# EasyEDA Pro project BlueberryPi.eprj, board PCB1 (continued)
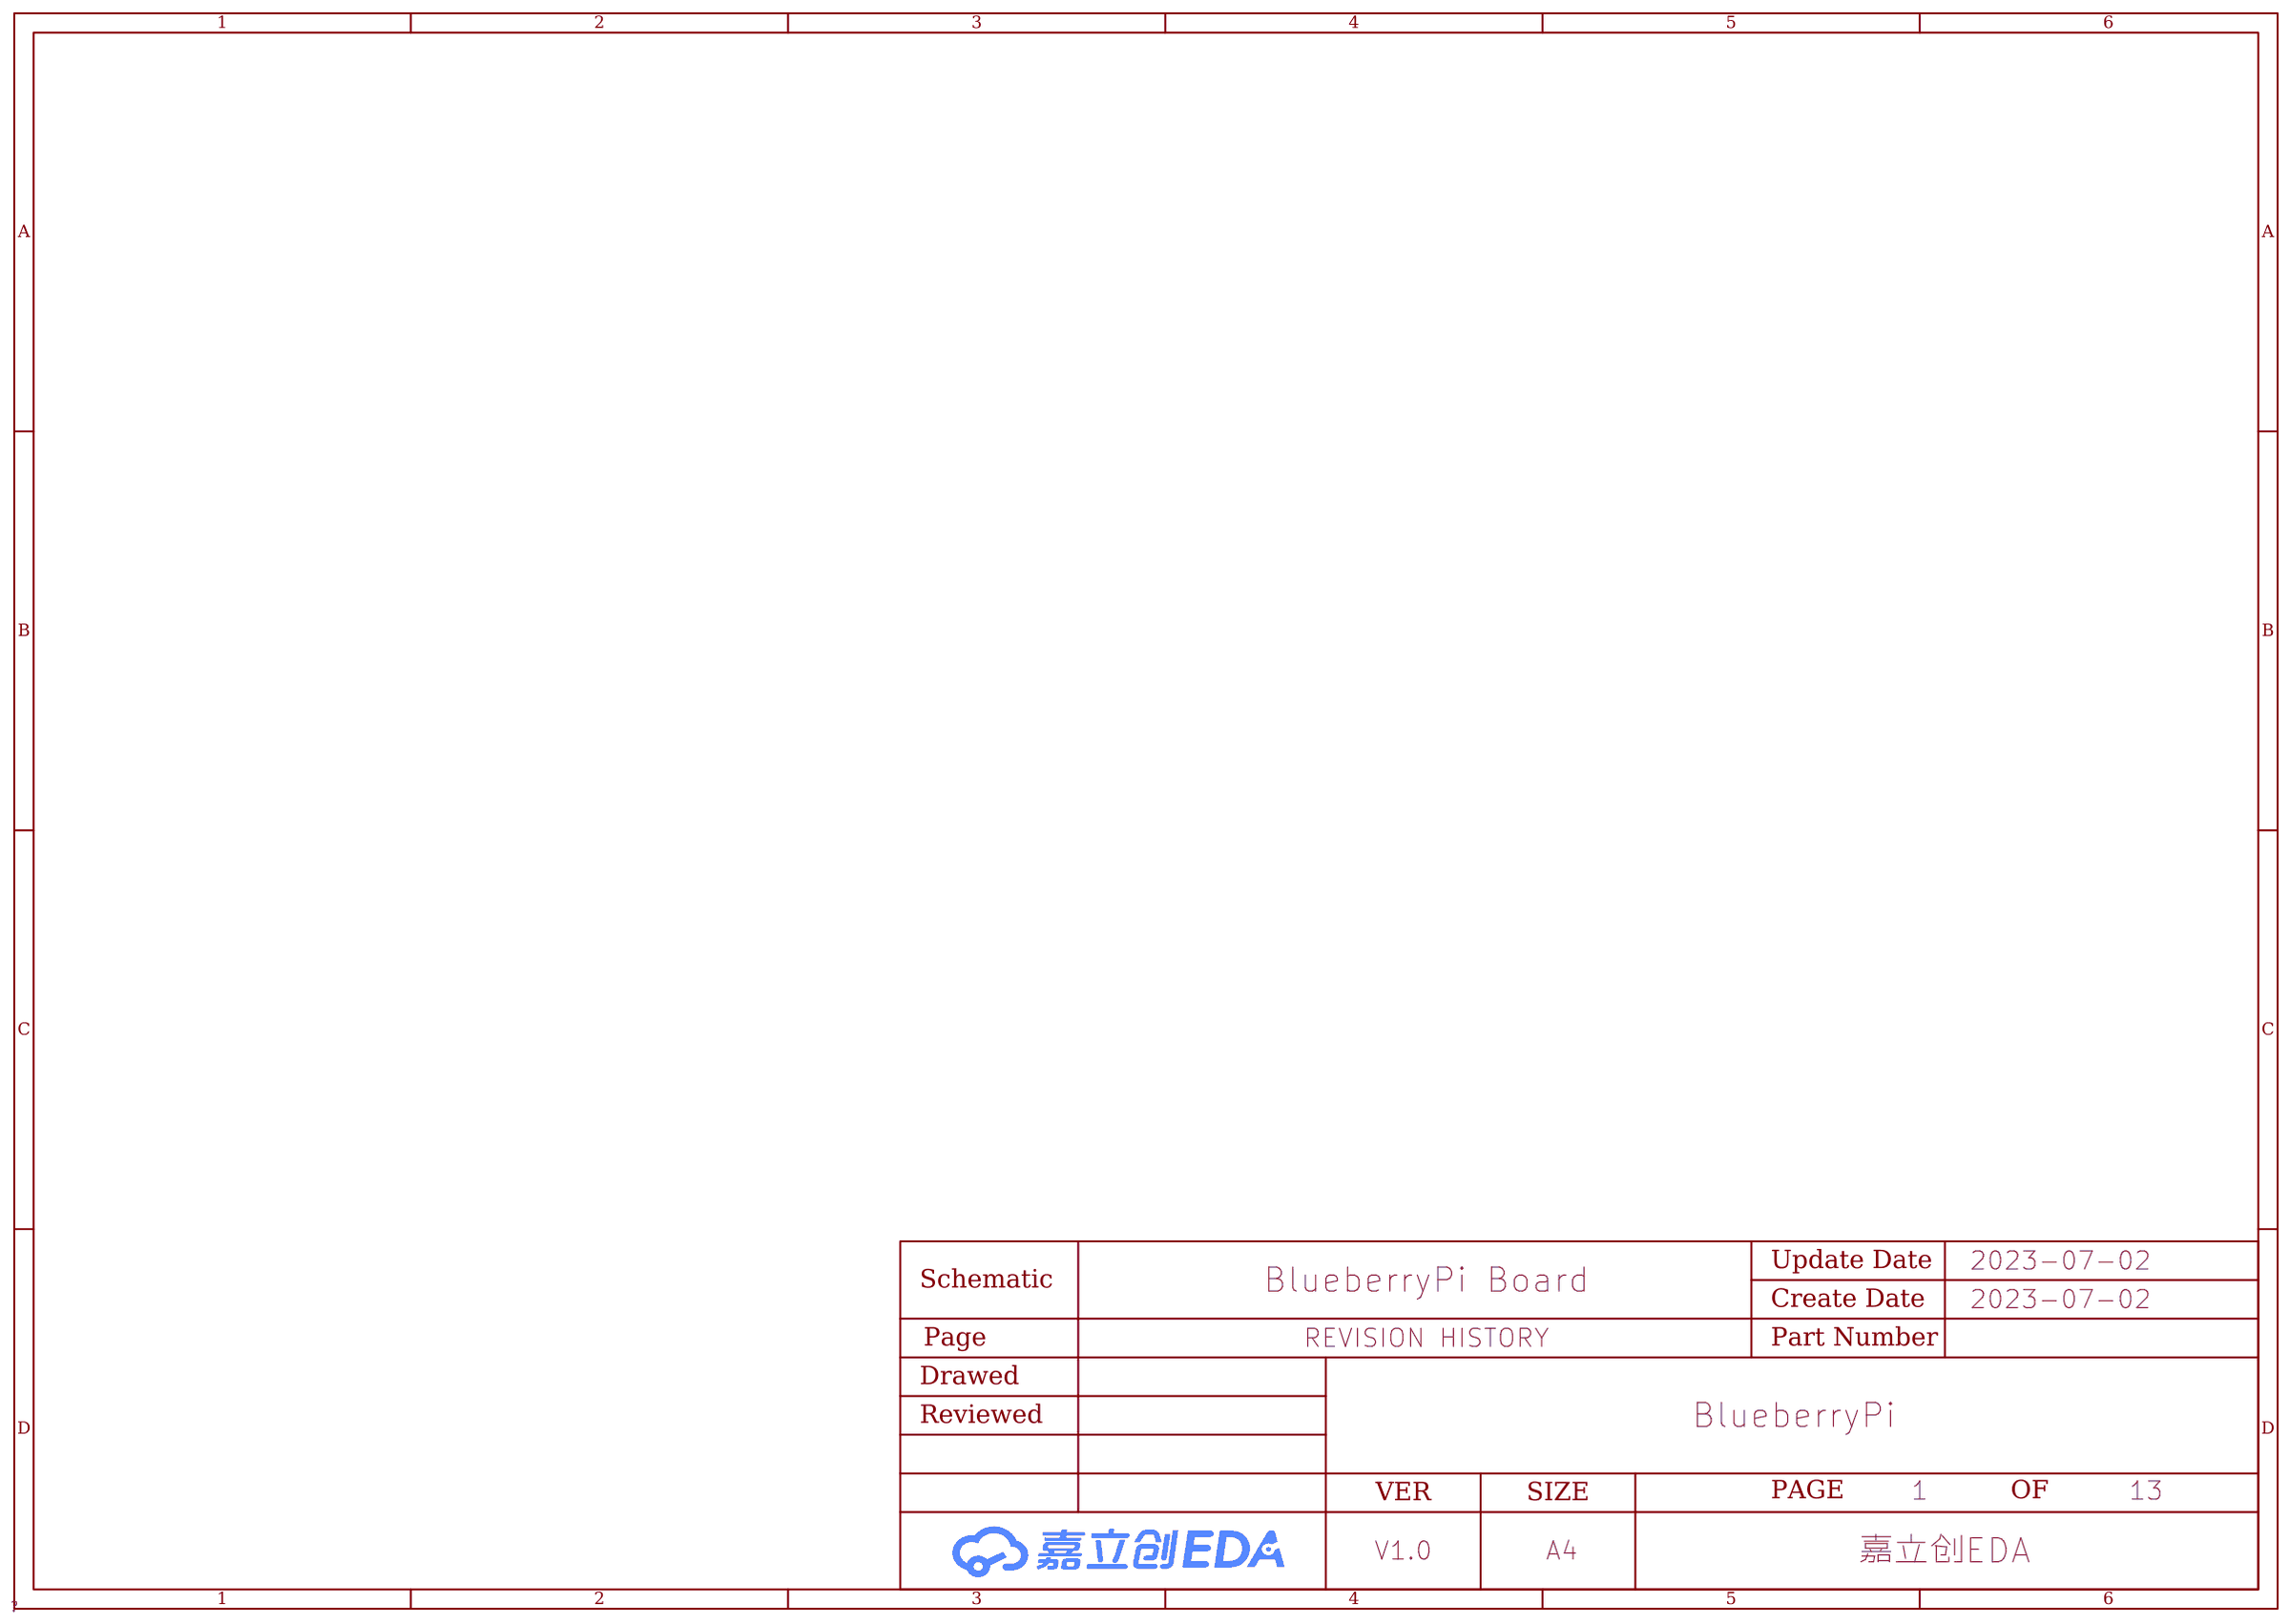
[diagram p0: REVISION HISTORY]
## Routing (per net, layer and track width the routed paths; a pad name or vN(x,y) marks a point on that pad's centre or on a via; arc(x,y) is an arc through that point) (continued)
HTX0P: length 40.8
  Top Layer w0.102: U1.A19 54.19,56.79 54.19,56.92 54.06,57.05 54.06,57.23 54.19,57.35 54.19,57.53 54.06,57.66 54.06,57.84 54.19,57.96 54.19,58.14 54.06,58.27 54.06,58.45 54.19,58.57 54.19,58.75 54.06,58.88 54.06,59.05 54.19,59.18 54.19,59.36 54.06,59.49 54.06,59.66 54.19,59.79 54.19,59.97 54.06,60.1 54.06,60.27 54.19,60.4 54.19,60.58 54.06,60.71 54.06,60.88 54.19,61.01 54.19,62.36 68.89,77.05 68.89,86.07 68.75,86.2 D3.1 D3.10 68.75,87.94 68.89,88.07 68.89,88.5 68.5,88.89 CN1.7
HTX1N: length 40.4
  Top Layer w0.102: CN1.6 68,88.89 67.62,88.5 67.62,88.07 67.75,87.94 D4.6 D4.5 67.75,86.2 67.62,86.07 67.62,77.6 53.75,63.74 53.75,56.35 U1.B18
HTX1P: length 40.4
  Top Layer w0.102: CN1.4 67,88.89 67.39,88.5 67.39,88.07 67.25,87.94 D4.7 D4.4 67.25,86.2 67.39,86.07 67.39,77.7 53.52,63.83 53.52,61 53.39,60.87 53.39,60.69 53.52,60.56 53.52,60.39 53.39,60.26 53.39,60.08 53.52,59.95 53.52,59.78 53.39,59.65 53.39,59.47 53.52,59.34 53.52,59.17 53.39,59.04 53.39,58.86 53.52,58.73 53.52,58.56 53.39,58.43 53.39,58.25 53.52,58.13 53.52,57.95 53.39,57.82 53.39,57.64 53.52,57.52 53.52,57.34 53.39,57.21 53.39,57.03 53.52,56.91 53.52,56.77 U1.A18
HTX2N: length 40.1
  Top Layer w0.102: U1.B17 53.1,56.35 53.1,65.41 66.12,78.43 66.12,86.07 66.25,86.2 D4.2 D4.9 66.25,87.94 66.12,88.07 66.12,88.5 66.5,88.89 CN1.3
HTX2P: length 40
  Top Layer w0.102: CN1.1 65.5,88.89 65.89,88.5 65.89,88.07 65.75,87.94 D4.10 D4.1 65.75,86.2 65.89,86.07 65.89,78.52 52.87,65.51 52.87,61 52.74,60.87 52.74,60.69 52.87,60.56 52.87,60.39 52.74,60.26 52.74,60.08 52.87,59.95 52.87,59.78 52.74,59.65 52.74,59.47 52.87,59.34 52.87,59.17 52.74,59.04 52.74,58.86 52.87,58.73 52.87,58.56 52.74,58.43 52.74,58.25 52.87,58.12 52.87,57.95 52.74,57.82 52.74,57.64 52.87,57.52 52.87,57.34 52.74,57.21 52.74,57.03 52.87,56.91 52.87,56.77 U1.A17
HTXCN: length 41.1
  Top Layer w0.102: U1.B20 54.74,56.03 55.08,56.37 55.08,60.55 70.62,76.08 70.62,86.07 70.75,86.2 D3.5 D3.6 70.75,87.94 70.62,88.07 70.62,88.5 71,88.89 CN1.12
HTXCP: length 41.1
  Top Layer w0.102: U1.A20 54.85,56.8 54.85,56.92 54.71,57.06 54.71,57.23 54.85,57.37 54.85,57.53 54.71,57.67 54.71,57.84 54.85,57.98 54.85,58.14 54.71,58.28 54.71,58.45 54.85,58.59 54.85,58.75 54.71,58.89 54.71,59.06 54.85,59.2 54.85,59.36 54.71,59.5 54.71,59.67 54.85,59.81 54.85,59.97 54.71,60.11 54.71,60.28 54.85,60.42 54.85,60.64 70.39,76.18 70.39,86.07 70.25,86.2 D3.4 D3.7 70.25,87.94 70.39,88.07 70.39,88.5 70,88.89 CN1.10
KEYADC: length 3
  Top Layer w0.127: U1.B21 55.74,56.39 v2(55.74,57.59)
  Bottom Layer w0.127: v2(55.74,57.59) 54.71,57.59 R12.1
LINEOUTL: length 65.6
  Bottom Layer w0.127: v2(43.03,54.69) 42.19,55.52 41.29,55.52 41.06,55.75 41.06,61.29 58.68,78.91 86.31,78.91 86.73,78.49 90.11,78.49 v2(90.93,79.31)
LINEOUTR: length 62.1
  Top Layer w0.127: v2(41.63,55.16) 41.82,55.16 42.13,54.85 42.26,54.85 U1.D1
  Bottom Layer w0.127: v2(87.66,79.31) 87.65,79.3 58.72,79.3 40.73,61.3 40.73,55.65 41.22,55.16 v2(41.63,55.16)
PD15: length 63.8
  Top Layer w0.127: U1.R3 43.33,47.93 36.82,47.93 34.18,45.29 34.18,14.46 35.86,12.77 39.85,12.77 41.81,10.81 41.81,9.07 42.74,8.14 50.28,8.14 U7.16
PD16: length 64.8
  Top Layer w0.127: U7.18 52.59,8.37 42.84,8.37 42.04,9.17 42.04,10.9 39.94,13 36.01,13 34.46,14.56 34.46,45.16 36.88,47.59 43.02,47.59 U1.R2
PD18: length 60.6
  Top Layer w0.127: U7.12 46.99,6.72 45.8,7.91 42.65,7.91 41.58,8.98 41.58,10.72 39.75,12.54 35.69,12.54 33.9,14.34 33.9,45.38 37.08,48.56 44,48.56 U1.P4
PD21: length 69.8
  Top Layer w0.127: U7.22 57.44,8.6 42.93,8.6 42.27,9.26 42.27,11 40.03,13.23 36.18,13.23 34.72,14.69 34.72,45.05 36.92,47.24 43.37,47.24 U1.T3
PL8: length 116.9
  Top Layer w0.127: U7.26 85.03,6.35 88.43,9.75 88.43,59.66 86.08,62.01 70.7,62.01 67.53,58.84 67.53,54.83 63.64,50.94 59.03,50.94 58.09,51.88 58.09,52.65 57.83,52.92 57.33,52.92 56.96,52.55 56.45,52.55 U1.H22
PL10: length 136.3
  Top Layer w0.127: U1.H21 55.4,52.13 v2(55.72,51.82)
  Bottom Layer w0.127: v2(55.72,51.82) 55.97,52.07 57.89,52.07 58.01,52.2 58.01,54.41 58.64,55.04 64.83,55.04 74.18,64.39 88.38,64.39 90.86,61.91 90.86,10.12 85.81,5.08 53.34,5.08 U7.15
PMU-SCK: length 73.1
  Top Layer w0.127: v2(27.1,56.46) 25.56,58 19.29,58 18.89,57.6 U37.23
  03SIG w0.127: v2(68.81,56.44) 63.64,61.61 42.76,61.61 42.25,61.1 32.08,61.1 28.33,57.34 27.98,57.34 27.1,56.46
  Bottom Layer w0.127: v2(68.81,56.44) 68.81,55.99 63.49,50.67 56.15,50.67 55.63,51.19 55.09,51.19 v2(54.73,50.83)
PMU-SDA: length 72.4
  Top Layer w0.127: U37.24 18.84,58 19.13,58.28 26.53,58.28 v2(27.1,57.71) ; U1.K23 57.84,50.83 58.77,49.9 63.89,49.9 69.29,55.3 v2(69.29,56.86)
  03SIG w0.127: v2(69.29,56.86) 64.19,61.96 42.33,61.96 41.82,61.45 30.84,61.45 v2(27.1,57.71)
PS: length 221
  Top Layer w0.203: U37.33 15.48,60.97 v2(15.27,61.18) 15.08,60.99 U37.34 ; v2(13.51,52.59) 13.51,52.73 v2(13.75,52.97) 13.88,53.1 U37.6 ; v2(17.46,52.92) v2(16.94,52.92) 16.94,52.95 16.68,53.21 U37.13 ; v2(12.36,52.58) 12.36,52.68 v2(12.64,52.96) 12.68,53 U37.3 ; v2(18.97,55.55) 18.93,55.6 U37.18 ; v2(11.2,55.8) 11.07,55.67 U37.53 ; v2(16.97,61.4) 16.68,61.12 U37.30
  Top Layer w0.305: v2(10.53,58.6) v2(11.21,58.6) ; U65.4 24.17,10.51 v2(24.17,11.71) v2(24.17,13.31) ; v2(11.2,55.8) v2(10.5,55.8) ; USB1.1 4.5,80.55 v2(6.03,82.08) 7.2,80.91 v2(7.2,79.38) 7.53,79.05 v2(7.53,77.5) 7.68,77.34 v2(7.68,75.89)
  Top Layer w0.508: U53.5 v2(58.61,76.71) 58.61,76.18 v2(58.09,75.67)
  04PWR w1.016: 41.31,82.92 41.47,82.92 42.71,81.67 v2(42.71,77.18) 42.71,76.18 v2(42.19,75.67) ; 41.31,82.92 28.95,82.92 ; 41.31,82.92 42.33,83.93 55.37,83.93 55.48,83.82 56.99,83.82 ; 6.91,82.16 7.67,82.92 9.11,82.92 ; 25.72,1.56 25.59,1.69 25.59,7.7 24.17,9.12 v2(24.17,11.71) v2(24.17,13.31) ; 25.72,1.56 28.25,1.56 33.03,6.35 U7.2 U7.4 ; 25.72,1.56 14.77,1.56 1.03,15.3 1.03,53.82 ; 56.99,83.82 58.61,82.21 v2(58.61,76.71) 58.61,76.18 v2(58.09,75.67) ; 56.99,83.82 80.19,83.82 v2(80.9,84.53) v2(81.41,84.53) ; 1.02,54.82 1.02,53.82 1.03,53.82 ; 28.95,82.92 9.11,82.92 ; 28.95,82.92 v2(30.37,81.5) 30.37,80.65 v2(29.85,80.14) ; 3.04,56.81 1.65,55.42 1.65,54.44 1.03,53.82 ; 9.11,82.92 7.59,81.41
  vias: v2(5.4,80.64) v2(5.4,79.38) v2(5.4,78.11) v2(6.03,80.64) v2(6.03,79.38) v2(6.03,78.11)
PWM0: length 57.3
  Top Layer w0.127: U1.U2 36.81,46.28 35.22,44.69 35.22,15.04 36.51,13.74 40.23,13.74 43.18,10.8 v2(43.18,9.03)
  Bottom Layer w0.127: U7.7 40.65,5.07 40.65,8.12 41.57,9.03 v2(43.18,9.03)
PWR-LED: length 20.5
  Bottom Layer w0.127: v2(72.91,57.15) 70.29,57.15 63.59,50.44 55.77,50.44 v2(55.38,50.83)
PWRON: length 131
  Top Layer w0.127: U38.1 19.02,60.38 17.89,60.38 17.3,59.78 17.3,59.33 17.43,59.2 U37.27
  Top Layer w0.305: v2(72.49,20.09) C134.2
  03SIG w0.127: U38.1 42.14,63.65 43,62.79 83.26,62.79 87.13,58.92 87.13,20.14 85.97,18.97 73.61,18.97 v2(72.49,20.09)
RECOVERY: length 74.2
  Top Layer w0.127: 56.03,51.48 56.3,51.75 57.89,51.75 58.96,50.69 63.71,50.69 67.81,54.78 67.81,58.65 70.89,61.73 79.91,61.73 81.72,59.92 81.72,39.08 R62.1
  Top Layer w0.305: SW4.2 71.62,28.98 ; R62.1 U25.2 74.56,28.98
S-UART-RX: length 108.2
  Top Layer w0.127: v2(45.41,10.47) 45.6,10.65 45.6,10.82 45.64,10.87 57.8,10.87 67.18,20.26 67.18,29.03 80.37,42.21 80.37,58.82 79.73,59.45 76.05,59.45 v2(75.88,59.61) ; U1.J20 v2(54.08,50.83)
  Bottom Layer w0.127: v2(54.08,50.83) 54.7,51.45 55.85,51.45 56.12,51.18 63.68,51.18 68.24,55.74 68.24,56.82 70.87,59.45 75.72,59.45 v2(75.88,59.61) ; v2(45.41,10.47) 45.24,10.47 44.45,9.68 44.45,8.42 43.31,7.28 43.31,6.4 43.35,6.35 U7.10
S-UART-TX: length 108.2
  Top Layer w0.127: v2(45.06,10.82) 45.24,11 45.42,11 45.54,11.12 57.69,11.12 66.93,20.36 66.93,29.13 80.11,42.32 80.11,58.71 79.63,59.19 71.01,59.19 68.35,56.54 68.35,54.68 63.83,50.17 58.83,50.17 57.81,51.18 56.62,51.18 56.27,50.83 U1.K22
  Bottom Layer w0.127: U7.8 43.01,6.35 43.05,6.4 43.05,7.38 43.13,7.46 arc(43.17,7.55) 43.13,7.64 42.8,7.97 arc(42.8,8.15) 42.98,8.15 43.31,7.82 arc(43.49,7.82) 43.49,8 43.16,8.33 arc(43.16,8.51) 43.34,8.51 43.67,8.18 arc(43.76,8.14) 43.85,8.18 44.2,8.53 44.2,9.78 45.06,10.64 v2(45.06,10.82)
SA0: length 36.7
  Top Layer w0.127: v2(53.11,25.12) 53.11,24.26 U35.R2
  Bottom Layer w0.127: v2(53.11,25.12) 52.69,25.12 52.39,25.41 51.61,25.41 51.46,25.56 51.46,25.83 51.59,25.96 54.25,25.96 54.56,26.26 54.56,27.38 54.64,27.46 arc(54.68,27.55) 54.64,27.64 54.5,27.79 arc(54.5,27.97) 54.68,27.97 54.82,27.82 arc(54.91,27.79) 55,27.82 55.09,27.92 55.09,29.02 54.76,29.35 54.76,29.84 55.22,30.3 55.22,31.48 arc(55.19,31.57) 55.1,31.61 54.39,31.61 arc(54.27,31.74) 54.39,31.87 55.1,31.87 arc(55.22,31.99) 55.1,32.12 54.49,32.12 arc(54.36,32.25) 54.49,32.37 55.1,32.37 arc(55.22,32.5) 55.1,32.63 54.88,32.63 arc(54.75,32.75) 54.88,32.88 55.1,32.88 arc(55.22,33.01) 55.1,33.14 54.88,33.14 arc(54.75,33.26) 54.88,33.39 55.1,33.39 arc(55.22,33.52) 55.1,33.64 54.88,33.64 arc(54.75,33.77) 54.88,33.9 55.1,33.9 arc(55.19,33.93) 55.22,34.02 55.22,34.18 55.16,34.25 arc(55.07,34.29) 54.98,34.25 54.89,34.16 arc(54.71,34.16) 54.71,34.34 54.8,34.43 arc(54.83,34.52) 54.8,34.61 54.7,34.71 54.7,42.26 53.92,43.04 53.35,43.04 arc(53.26,43) 53.23,42.91 53.23,42.63 arc(53.1,42.51) 52.97,42.63 52.97,42.91 arc(52.85,43.04) 52.72,42.91 52.72,42.63 arc(52.59,42.51) 52.46,42.63 52.46,42.91 arc(52.43,43) 52.34,43.04 52.12,43.04 52.05,43.11 arc(52.01,43.2) 52.05,43.29 52.33,43.57 arc(52.33,43.75) 52.15,43.75 51.87,43.47 arc(51.78,43.44) 51.69,43.47 v2(51.48,43.68)
SA1: length 36.5
  Top Layer w0.127: v2(52.53,24.32) 52.78,24.07 U35.P2
  Bottom Layer w0.127: v2(52.78,43.68) 52.78,43.46 52.91,43.33 53.18,43.33 arc(53.27,43.37) 53.31,43.46 53.31,43.7 arc(53.44,43.83) 53.56,43.7 53.56,43.46 arc(53.6,43.37) 53.69,43.33 53.98,43.33 54.98,42.33 54.98,34.83 55.89,33.92 55.89,33.72 arc(55.85,33.63) 55.76,33.59 55.58,33.59 arc(55.45,33.46) 55.58,33.34 55.76,33.34 arc(55.89,33.21) 55.76,33.08 55.58,33.08 arc(55.45,32.95) 55.58,32.83 55.76,32.83 arc(55.89,32.7) 55.76,32.57 55.58,32.57 arc(55.45,32.45) 55.58,32.32 55.76,32.32 arc(55.89,32.19) 55.76,32.06 55.58,32.06 arc(55.45,31.94) 55.58,31.81 55.76,31.81 arc(55.89,31.68) 55.76,31.56 55.58,31.56 arc(55.45,31.43) 55.58,31.3 55.76,31.3 arc(55.89,31.18) 55.76,31.05 55.58,31.05 arc(55.45,30.92) 55.58,30.8 55.76,30.8 arc(55.89,30.67) 55.76,30.54 55.58,30.54 arc(55.45,30.41) 55.58,30.29 55.76,30.29 arc(55.89,30.16) 55.76,30.03 55.61,30.03 arc(55.48,29.91) 55.61,29.78 55.76,29.78 arc(55.89,29.65) 55.76,29.53 55.74,29.53 arc(55.61,29.4) 55.74,29.27 55.76,29.27 arc(55.89,29.14) 55.76,29.02 55.53,29.02 arc(55.41,28.89) 55.53,28.76 55.76,28.76 arc(55.89,28.64) 55.76,28.51 55.53,28.51 arc(55.4,28.38) 55.53,28.25 55.76,28.25 arc(55.89,28.13) 55.76,28 55.48,28 arc(55.36,27.87) 55.48,27.75 55.76,27.75 arc(55.89,27.62) 55.76,27.49 55.48,27.49 arc(55.36,27.37) 55.48,27.24 55.76,27.24 arc(55.85,27.2) 55.89,27.11 55.89,26.83 55.83,26.78 arc(55.74,26.74) 55.65,26.78 55.06,27.38 arc(54.88,27.38) 54.88,27.2 55.47,26.6 arc(55.47,26.42) 55.29,26.42 55.06,26.66 arc(54.88,26.66) 54.88,26.48 55.12,26.24 arc(55.11,26.06) 54.94,26.06 54.9,26.1 arc(54.72,26.1) 54.72,25.92 54.76,25.88 arc(54.79,25.79) 54.76,25.7 53.81,24.76 52.96,24.76 v2(52.53,24.32)
SA2: length 36.6
  Bottom Layer w0.127: v2(54.08,43.68) 55.4,42.36 arc(55.44,42.27) 55.4,42.18 55.29,42.07 arc(55.29,41.89) 55.47,41.89 55.58,42 arc(55.67,42.03) 55.76,42 55.79,41.97 ; 55.79,41.97 55.79,41.71 arc(55.75,41.62) 55.66,41.58 55.33,41.58 arc(55.21,41.45) 55.33,41.33 55.66,41.33 arc(55.79,41.2) 55.66,41.07 55.33,41.07 arc(55.21,40.94) 55.33,40.82 55.66,40.82 arc(55.79,40.69) 55.66,40.56 55.33,40.56 arc(55.21,40.44) 55.33,40.31 55.66,40.31 arc(55.79,40.18) 55.66,40.06 55.33,40.06 arc(55.21,39.93) 55.33,39.8 55.66,39.8 arc(55.79,39.67) 55.66,39.55 55.33,39.55 arc(55.21,39.42) 55.33,39.29 55.66,39.29 arc(55.79,39.17) 55.66,39.04 55.33,39.04 arc(55.21,38.91) 55.33,38.78 55.66,38.78 arc(55.79,38.66) 55.66,38.53 55.33,38.53 arc(55.21,38.4) 55.33,38.28 55.66,38.28 arc(55.79,38.15) 55.66,38.02 55.33,38.02 arc(55.21,37.9) 55.33,37.77 55.66,37.77 arc(55.79,37.64) 55.66,37.52 55.33,37.52 arc(55.21,37.39) 55.33,37.26 55.66,37.26 arc(55.79,37.13) 55.66,37.01 55.33,37.01 arc(55.21,36.88) 55.33,36.75 55.66,36.75 arc(55.79,36.63) 55.66,36.5 55.33,36.5 arc(55.21,36.37) 55.33,36.25 55.66,36.25 arc(55.79,36.12) 55.66,35.99 55.33,35.99 arc(55.21,35.86) 55.33,35.74 55.66,35.74 arc(55.79,35.61) 55.66,35.48 55.33,35.48 arc(55.21,35.36) 55.33,35.23 55.66,35.23 arc(55.75,35.19) 55.79,35.1 55.79,34.85 55.86,34.78 arc(55.9,34.69) 55.86,34.6 55.79,34.52 arc(55.79,34.34) 55.97,34.34 56.04,34.42 arc(56.13,34.45) 56.22,34.42 56.24,34.4 56.24,26.56 53.62,23.94 v2(52.16,23.94)
SA3: length 36.5
  Bottom Layer w0.127: v2(52.13,24.74) 51.7,24.31 51.7,23.85 52.01,23.55 53.87,23.55 56.58,26.26 56.58,34.66 arc(56.54,34.75) 56.45,34.79 56.25,34.79 arc(56.12,34.92) 56.25,35.04 56.45,35.04 arc(56.58,35.17) 56.45,35.3 56.25,35.3 arc(56.12,35.42) 56.25,35.55 56.45,35.55 arc(56.58,35.68) 56.45,35.81 56.25,35.81 arc(56.12,35.93) 56.25,36.06 56.45,36.06 arc(56.58,36.19) 56.45,36.31 56.25,36.31 arc(56.12,36.44) 56.25,36.57 56.45,36.57 arc(56.58,36.7) 56.45,36.82 56.25,36.82 arc(56.12,36.95) 56.25,37.08 56.45,37.08 arc(56.58,37.2) 56.45,37.33 56.25,37.33 arc(56.12,37.46) 56.25,37.58 56.45,37.58 arc(56.58,37.71) 56.45,37.84 56.25,37.84 arc(56.12,37.97) 56.25,38.09 56.45,38.09 arc(56.58,38.22) 56.45,38.35 56.25,38.35 arc(56.12,38.47) 56.25,38.6 56.45,38.6 arc(56.58,38.73) 56.45,38.85 56.25,38.85 arc(56.12,38.98) 56.25,39.11 56.45,39.11 arc(56.58,39.23) 56.45,39.36 56.25,39.36 arc(56.12,39.49) 56.25,39.62 56.45,39.62 arc(56.58,39.74) 56.45,39.87 56.25,39.87 arc(56.12,40) 56.25,40.12 56.45,40.12 arc(56.58,40.25) 56.45,40.38 56.25,40.38 arc(56.12,40.5) 56.25,40.63 56.45,40.63 arc(56.58,40.76) 56.45,40.89 56.25,40.89 arc(56.12,41.01) 56.25,41.14 56.45,41.14 arc(56.54,41.18) 56.58,41.27 56.58,41.5 56.45,41.63 arc(56.36,41.67) 56.27,41.63 56.24,41.59 arc(56.06,41.6) 56.06,41.77 56.09,41.81 arc(56.13,41.9) 56.09,41.99 55.97,42.12 55.97,42.58 55.91,42.64 arc(55.82,42.67) 55.73,42.64 55.7,42.6 arc(55.52,42.6) 55.52,42.78 55.55,42.82 arc(55.55,43) 55.37,43 55.34,42.96 arc(55.16,42.96) 55.16,43.14 55.19,43.18 arc(55.19,43.36) 55.01,43.36 54.98,43.32 arc(54.8,43.32) 54.8,43.5 54.83,43.53 arc(54.87,43.62) 54.83,43.71 54.73,43.81 v2(54.73,44.33)
SA4: length 36.6
  Top Layer w0.127: v2(51.68,25.02) 51.48,24.82 U35.M3
  Bottom Layer w0.127: v2(51.68,25.02) 51.21,24.55 51.21,23.81 51.77,23.25 54.14,23.25 arc(54.23,23.28) 54.27,23.37 54.27,23.57 arc(54.4,23.7) 54.52,23.57 54.52,23.37 arc(54.56,23.28) 54.65,23.25 54.75,23.25 54.91,23.41 arc(54.95,23.5) 54.91,23.59 54.78,23.73 arc(54.78,23.91) 54.96,23.91 55.09,23.77 arc(55.27,23.77) 55.27,23.95 55.14,24.09 arc(55.14,24.27) 55.32,24.27 55.45,24.13 arc(55.63,24.13) 55.63,24.31 55.5,24.44 arc(55.5,24.62) 55.68,24.62 55.81,24.49 arc(55.99,24.49) 55.99,24.67 55.86,24.8 arc(55.86,24.98) 56.04,24.98 56.17,24.85 arc(56.35,24.85) 56.35,25.03 56.22,25.16 arc(56.22,25.34) 56.4,25.34 56.53,25.21 arc(56.62,25.17) 56.71,25.21 56.88,25.38 56.88,25.48 arc(56.85,25.57) 56.76,25.61 56.6,25.61 arc(56.47,25.73) 56.6,25.86 56.76,25.86 arc(56.85,25.9) 56.88,25.99 56.88,41.59 56.31,42.16 56.31,43.26 54.88,44.69 54.44,44.69 54.07,44.33 53.69,44.33 53.33,44.69 52.49,44.69 v2(52.13,44.33)
SA5: length 36.7
  Bottom Layer w0.127: v2(48.23,44.33) 48.23,44.08 arc(48.19,43.99) 48.1,43.96 47.34,43.96 arc(47.22,43.83) 47.34,43.7 48.1,43.7 arc(48.19,43.66) 48.23,43.58 48.23,43.48 47.81,43.06 arc(47.72,43.02) 47.63,43.06 47.42,43.27 arc(47.24,43.27) 47.24,43.09 47.45,42.88 arc(47.45,42.7) 47.27,42.7 47.08,42.89 arc(46.9,42.89) 46.9,42.71 47.09,42.52 arc(47.09,42.34) 46.91,42.34 46.8,42.45 arc(46.62,42.45) 46.62,42.28 46.73,42.16 arc(46.73,41.98) 46.55,41.98 46.44,42.1 arc(46.26,42.1) 46.26,41.92 46.37,41.8 arc(46.41,41.71) 46.37,41.62 43.72,38.97 43.72,37.94 43.37,37.59 43.37,37.33 arc(43.41,37.24) 43.5,37.2 43.52,37.2 arc(43.65,37.07) 43.52,36.95 43.5,36.95 arc(43.37,36.82) 43.5,36.69 43.52,36.69 arc(43.65,36.57) 43.52,36.44 43.5,36.44 arc(43.37,36.31) 43.5,36.19 43.52,36.19 arc(43.65,36.06) 43.52,35.93 43.5,35.93 arc(43.37,35.8) 43.5,35.68 43.52,35.68 arc(43.65,35.55) 43.52,35.42 43.5,35.42 arc(43.37,35.3) 43.5,35.17 43.52,35.17 arc(43.65,35.04) 43.52,34.92 43.5,34.92 arc(43.37,34.79) 43.5,34.66 43.52,34.66 arc(43.65,34.53) 43.52,34.41 43.5,34.41 arc(43.37,34.28) 43.5,34.15 43.52,34.15 arc(43.65,34.03) 43.52,33.9 43.5,33.9 arc(43.37,33.77) 43.5,33.65 43.52,33.65 arc(43.65,33.52) 43.52,33.39 43.5,33.39 arc(43.37,33.26) 43.5,33.14 43.52,33.14 arc(43.65,33.01) 43.52,32.88 43.5,32.88 arc(43.37,32.76) 43.5,32.63 43.52,32.63 arc(43.65,32.5) 43.52,32.38 43.5,32.38 arc(43.37,32.25) 43.5,32.12 43.52,32.12 arc(43.65,31.99) 43.52,31.87 43.5,31.87 arc(43.41,31.83) 43.37,31.74 43.37,30.43 43.95,29.84 43.95,29.21 43.54,28.79 43.54,28.63 arc(43.57,28.54) 43.66,28.5 43.68,28.5 arc(43.81,28.37) 43.68,28.25 43.66,28.25 arc(43.57,28.21) 43.54,28.12 43.54,27.99 43.74,27.79 arc(43.83,27.75) 43.92,27.79 44.33,28.2 arc(44.51,28.2) 44.51,28.02 44.1,27.61 arc(44.1,27.43) 44.28,27.43 44.66,27.81 arc(44.84,27.81) 44.84,27.63 44.46,27.25 arc(44.42,27.16) 44.46,27.07 44.79,26.73 47.19,26.73 47.58,26.35 v2(47.58,24.74)
SA6: length 36.6
  Bottom Layer w0.127: v2(46.93,44.33) 46.93,44.01 arc(46.89,43.92) 46.8,43.89 46.77,43.89 arc(46.64,43.76) 46.77,43.63 46.8,43.63 arc(46.89,43.6) 46.93,43.51 46.93,43.24 46.82,43.13 arc(46.73,43.09) 46.64,43.13 46.51,43.26 arc(46.34,43.26) 46.34,43.08 46.46,42.95 arc(46.46,42.77) 46.28,42.77 45.89,43.16 arc(45.71,43.16) 45.71,42.98 46.1,42.59 arc(46.1,42.41) 45.92,42.41 45.57,42.76 arc(45.39,42.76) 45.39,42.58 45.74,42.23 arc(45.78,42.14) 45.74,42.05 arc(45.7,41.96) 45.74,41.87 45.93,41.68 arc(45.93,41.5) 45.75,41.5 45.56,41.69 arc(45.38,41.69) 45.38,41.51 45.57,41.33 arc(45.57,41.15) 45.39,41.15 45.2,41.34 arc(45.02,41.34) 45.02,41.16 45.21,40.97 arc(45.21,40.79) 45.03,40.79 44.84,40.98 arc(44.66,40.98) 44.66,40.8 44.85,40.61 arc(44.85,40.43) 44.67,40.43 44.49,40.62 arc(44.31,40.62) 44.31,40.44 44.49,40.25 arc(44.49,40.07) 44.31,40.07 44.13,40.26 arc(43.95,40.26) 43.95,40.08 44.14,39.89 arc(44.14,39.71) 43.96,39.71 43.77,39.9 arc(43.59,39.9) 43.59,39.72 43.78,39.53 arc(43.78,39.35) 43.6,39.35 43.41,39.54 arc(43.32,39.58) 43.23,39.54 43.09,39.41 43.09,39.28 arc(43.13,39.19) 43.22,39.15 43.29,39.15 arc(43.42,39.02) 43.29,38.9 43.22,38.9 arc(43.13,38.86) 43.09,38.77 arc(43.13,38.68) 43.22,38.64 43.28,38.64 arc(43.41,38.51) 43.28,38.39 43.22,38.39 arc(43.09,38.26) 43.22,38.13 43.28,38.13 arc(43.41,38.01) 43.28,37.88 43.22,37.88 arc(43.13,37.84) 43.09,37.75 43.09,27.41 43.22,27.29 arc(43.3,27.25) 43.39,27.29 43.57,27.46 arc(43.75,27.46) 43.75,27.28 43.57,27.11 arc(43.57,26.93) 43.75,26.93 43.93,27.1 arc(44.11,27.1) 44.1,26.92 43.93,26.75 arc(43.93,26.57) 44.11,26.57 44.28,26.74 arc(44.46,26.74) 44.46,26.56 44.29,26.39 arc(44.26,26.3) 44.29,26.21 44.55,25.95 45.9,25.95 46.93,24.92 v2(46.93,24.74)
SA7: length 36.7
  Bottom Layer w0.127: v2(44.98,43.68) 44.98,43.38 arc(45.02,43.29) 45.11,43.25 45.25,43.25 arc(45.38,43.12) 45.25,43 45.11,43 arc(45.02,42.96) 44.98,42.87 44.98,42.64 44.91,42.57 arc(44.87,42.48) 44.91,42.39 45.24,42.05 arc(45.24,41.88) 45.06,41.88 44.73,42.21 arc(44.55,42.21) 44.55,42.03 44.88,41.7 arc(44.88,41.52) 44.7,41.52 44.37,41.85 arc(44.19,41.85) 44.19,41.67 44.52,41.34 arc(44.52,41.16) 44.34,41.16 44.01,41.49 arc(43.83,41.49) 43.83,41.31 44.16,40.98 arc(44.16,40.8) 43.98,40.8 43.65,41.13 arc(43.47,41.13) 43.47,40.95 43.8,40.62 arc(43.8,40.44) 43.62,40.44 43.29,40.77 arc(43.11,40.77) 43.11,40.59 43.44,40.26 arc(43.44,40.08) 43.26,40.08 42.93,40.41 arc(42.84,40.45) 42.75,40.41 42.7,40.36 42.7,40.13 arc(42.73,40.04) 42.82,40.01 42.94,40.01 arc(43.07,39.88) 42.94,39.75 42.82,39.75 arc(42.73,39.71) 42.7,39.62 42.7,26.95 42.81,26.84 arc(42.9,26.8) 42.99,26.84 43.07,26.93 arc(43.25,26.93) 43.25,26.75 43.17,26.66 arc(43.17,26.48) 43.35,26.48 43.43,26.57 arc(43.61,26.57) 43.61,26.39 43.53,26.3 arc(43.53,26.12) 43.71,26.12 43.79,26.21 arc(43.97,26.21) 43.97,26.03 43.88,25.94 arc(43.88,25.76) 44.06,25.76 44.15,25.85 arc(44.33,25.85) 44.33,25.67 44.24,25.58 arc(44.21,25.49) 44.24,25.4 44.59,25.06 44.66,25.06 arc(44.75,25.09) 44.79,25.18 44.79,25.59 arc(44.92,25.72) 45.04,25.59 45.04,25.18 arc(45.17,25.06) 45.3,25.18 45.3,25.59 arc(45.43,25.72) 45.55,25.59 45.55,25.18 arc(45.59,25.09) 45.68,25.06 45.86,25.06 45.94,24.98 arc(46.03,24.94) 46.12,24.98 46.24,25.1 arc(46.42,25.1) 46.42,24.92 46.3,24.8 arc(46.26,24.71) 46.3,24.62 46.93,23.99 v2(46.93,23.94)
SA8: length 36.5
  Bottom Layer w0.127: v2(46.28,23.94) 46.28,23.96 45.76,24.49 44.63,24.49 42.29,26.83 42.29,40.58 arc(42.33,40.67) 42.42,40.71 42.66,40.71 arc(42.78,40.84) 42.66,40.96 42.42,40.96 arc(42.33,41) 42.29,41.09 42.29,41.39 42.35,41.44 arc(42.44,41.48) 42.53,41.44 42.9,41.07 arc(43.08,41.07) 43.08,41.25 42.71,41.62 arc(42.71,41.8) 42.89,41.8 43.26,41.43 arc(43.44,41.43) 43.44,41.61 43.07,41.98 arc(43.07,42.16) 43.25,42.16 43.62,41.79 arc(43.8,41.79) 43.8,41.97 43.43,42.34 arc(43.43,42.52) 43.6,42.52 43.98,42.15 arc(44.16,42.15) 44.16,42.33 43.78,42.7 arc(43.75,42.79) 43.78,42.88 43.85,42.95 ; 43.85,42.95 44.03,42.95 44.41,42.57 arc(44.59,42.57) 44.59,42.75 43.91,43.43 arc(43.91,43.61) 44.09,43.61 44.48,43.22 arc(44.66,43.22) 44.66,43.4 44.27,43.79 arc(44.24,43.88) 44.27,43.97 44.5,44.2 45.08,44.2 arc(45.17,44.23) 45.21,44.32 45.21,44.34 arc(45.33,44.47) 45.46,44.34 45.46,43.54 arc(45.59,43.41) 45.71,43.54 45.71,44.07 arc(45.75,44.16) 45.84,44.2 45.96,44.2 46.28,43.88 v2(46.28,43.68) ; 43.85,42.95 43.85,42.95 ; 43.85,42.95 arc(43.85,42.95) 43.85,42.95
SA9: length 36.7
  Bottom Layer w0.127: v2(43.68,44.33) 43.46,44.11 arc(43.43,44.02) 43.46,43.94 43.6,43.8 arc(43.6,43.62) 43.42,43.62 43.28,43.75 arc(43.11,43.76) 43.1,43.58 43.24,43.44 arc(43.24,43.26) 43.06,43.26 42.93,43.4 arc(42.75,43.4) 42.75,43.22 42.99,42.98 arc(42.99,42.8) 42.81,42.8 42.57,43.04 arc(42.39,43.04) 42.39,42.86 42.63,42.62 arc(42.63,42.44) 42.45,42.44 42.21,42.68 arc(42.12,42.71) 42.03,42.68 41.89,42.54 41.89,26.73 arc(41.93,26.64) 42.02,26.61 42.14,26.61 arc(42.26,26.48) 42.14,26.35 42.02,26.35 arc(41.89,26.23) 42.02,26.1 42.14,26.1 arc(42.26,25.97) 42.14,25.84 42.02,25.84 arc(41.93,25.81) 41.89,25.72 41.89,25.5 41.98,25.41 arc(42.07,25.37) 42.16,25.41 42.68,25.93 arc(42.86,25.93) 42.86,25.75 42.34,25.23 arc(42.34,25.05) 42.52,25.05 43.04,25.58 arc(43.22,25.58) 43.22,25.4 42.7,24.87 arc(42.7,24.69) 42.88,24.69 43.4,25.22 arc(43.58,25.22) 43.58,25.04 43.05,24.51 arc(43.05,24.33) 43.23,24.33 43.76,24.86 arc(43.94,24.86) 43.94,24.68 43.41,24.15 arc(43.38,24.06) 43.41,23.97 43.45,23.94 43.66,23.94 arc(43.75,23.98) 43.79,24.07 43.79,24.13 arc(43.92,24.26) 44.05,24.13 44.05,24.07 arc(44.17,23.94) 44.3,24.07 44.3,24.13 arc(44.43,24.26) 44.55,24.13 44.55,24.07 arc(44.68,23.94) 44.81,24.07 44.81,24.13 arc(44.93,24.26) 45.06,24.13 45.06,24.07 arc(45.1,23.98) 45.19,23.94 v2(45.63,23.94)
SCKE0: length 36.6
  Top Layer w0.127: U35.K3 50.18,24.7 v2(50.55,24.33)
  Bottom Layer w0.127: v2(50.55,24.33) 50.55,23.9 51.48,22.97 55.16,22.97 55.33,23.13 arc(55.36,23.21) 55.33,23.28 arc(55.3,23.35) 55.33,23.43 55.36,23.46 arc(55.43,23.49) 55.51,23.46 arc(55.58,23.43) 55.65,23.46 55.69,23.49 arc(55.72,23.56) 55.69,23.64 arc(55.66,23.71) 55.69,23.79 55.72,23.82 arc(55.79,23.85) 55.87,23.82 arc(55.94,23.79) 56.01,23.82 56.04,23.85 arc(56.08,23.92) 56.04,24 arc(56.01,24.07) 56.04,24.14 56.08,24.18 arc(56.15,24.21) 56.22,24.18 arc(56.3,24.15) 56.37,24.18 56.4,24.21 arc(56.43,24.28) 56.4,24.36 arc(56.37,24.43) 56.4,24.5 56.44,24.54 arc(56.51,24.57) 56.58,24.54 arc(56.66,24.51) 56.73,24.54 56.76,24.57 arc(56.79,24.64) 56.76,24.72 arc(56.73,24.79) 56.76,24.86 56.8,24.9 arc(56.87,24.93) 56.94,24.9 arc(57.02,24.87) 57.09,24.9 57.18,24.98 57.18,42.81 54.99,45 51.72,45 arc(51.63,44.96) 51.6,44.87 51.6,44.26 arc(51.47,44.13) 51.34,44.26 51.34,44.87 arc(51.31,44.96) 51.22,45 50.85,45 v2(50.83,44.98)
SCKE1: length 36.7
  Top Layer w0.127: v2(48.22,23.34) 48.55,23.67 48.55,24.82 48.87,25.15 49.71,25.15 v2(50.1,25.54)
  Bottom Layer w0.127: v2(48.22,23.34) 48.21,23.36 43.57,23.36 41.55,25.37 41.55,42.87 43.38,44.69 48.52,44.69 v2(48.88,44.33)
SCKN: length 36.6
  Top Layer w0.102: v2(49.25,41.58) 49.2,41.63 49.2,42.7 U1.AB12
  Bottom Layer w0.102: v2(49.25,41.58) 49.25,41.57 49.42,41.4 49.42,40.52 arc(49.39,40.45) 49.31,40.42 49.11,40.42 arc(48.78,40.09) 49.11,39.76 49.31,39.76 arc(49.42,39.65) 49.31,39.55 49,39.55 arc(48.67,39.22) 49,38.89 49.31,38.89 arc(49.42,38.79) 49.31,38.69 49,38.69 arc(48.67,38.36) 49,38.03 49.31,38.03 arc(49.42,37.93) 49.31,37.83 49,37.83 arc(48.67,37.5) 49,37.17 49.31,37.17 arc(49.42,37.06) 49.31,36.96 49,36.96 arc(48.67,36.63) 49,36.3 49.31,36.3 arc(49.42,36.2) 49.31,36.1 49,36.1 arc(48.67,35.77) 49,35.44 49.31,35.44 arc(49.42,35.34) 49.31,35.23 49,35.23 arc(48.67,34.9) 49,34.57 49.31,34.57 arc(49.42,34.47) 49.31,34.37 49,34.37 arc(48.67,34.04) 49,33.71 49.31,33.71 arc(49.42,33.61) 49.31,33.51 49,33.51 arc(48.67,33.18) 49,32.85 49.31,32.85 arc(49.39,32.82) 49.42,32.75 49.42,31.62 arc(49.39,31.54) 49.31,31.52 49.16,31.52 arc(48.83,31.19) 49.16,30.85 49.31,30.85 arc(49.42,30.75) 49.31,30.65 49.16,30.65 arc(48.83,30.32) 49.16,29.99 49.31,29.99 arc(49.42,29.89) 49.31,29.79 49.16,29.79 arc(48.83,29.46) 49.16,29.13 49.31,29.13 arc(49.39,29.1) 49.42,29.03 49.42,28.33 arc(49.39,28.26) 49.31,28.23 48.02,28.23 arc(47.69,27.9) 48.02,27.57 49.31,27.57 arc(49.42,27.46) 49.31,27.36 48.91,27.36 arc(48.58,27.03) 48.91,26.7 49.31,26.7 arc(49.39,26.67) 49.42,26.6 49.42,26.43 48.95,25.96 48.95,24.59 49.31,24.22 49.49,24.22 49.56,24.16 v2(49.56,23.95)
